# EasyEDA Pro project RN8302B-c8t6 V3.1.eprj, schematic Schematic1

## Sheets
1 stm32主电路: Create Date: 2024-05-13; Page Name: stm32主电路; Project Name: 电能计量模块BC20; Schematic Name: Schematic1; Update Date: 2024-06-25; Company: ls; Drawed: ls; Page Size: A3; Reviewed: ls; Version: V1.0
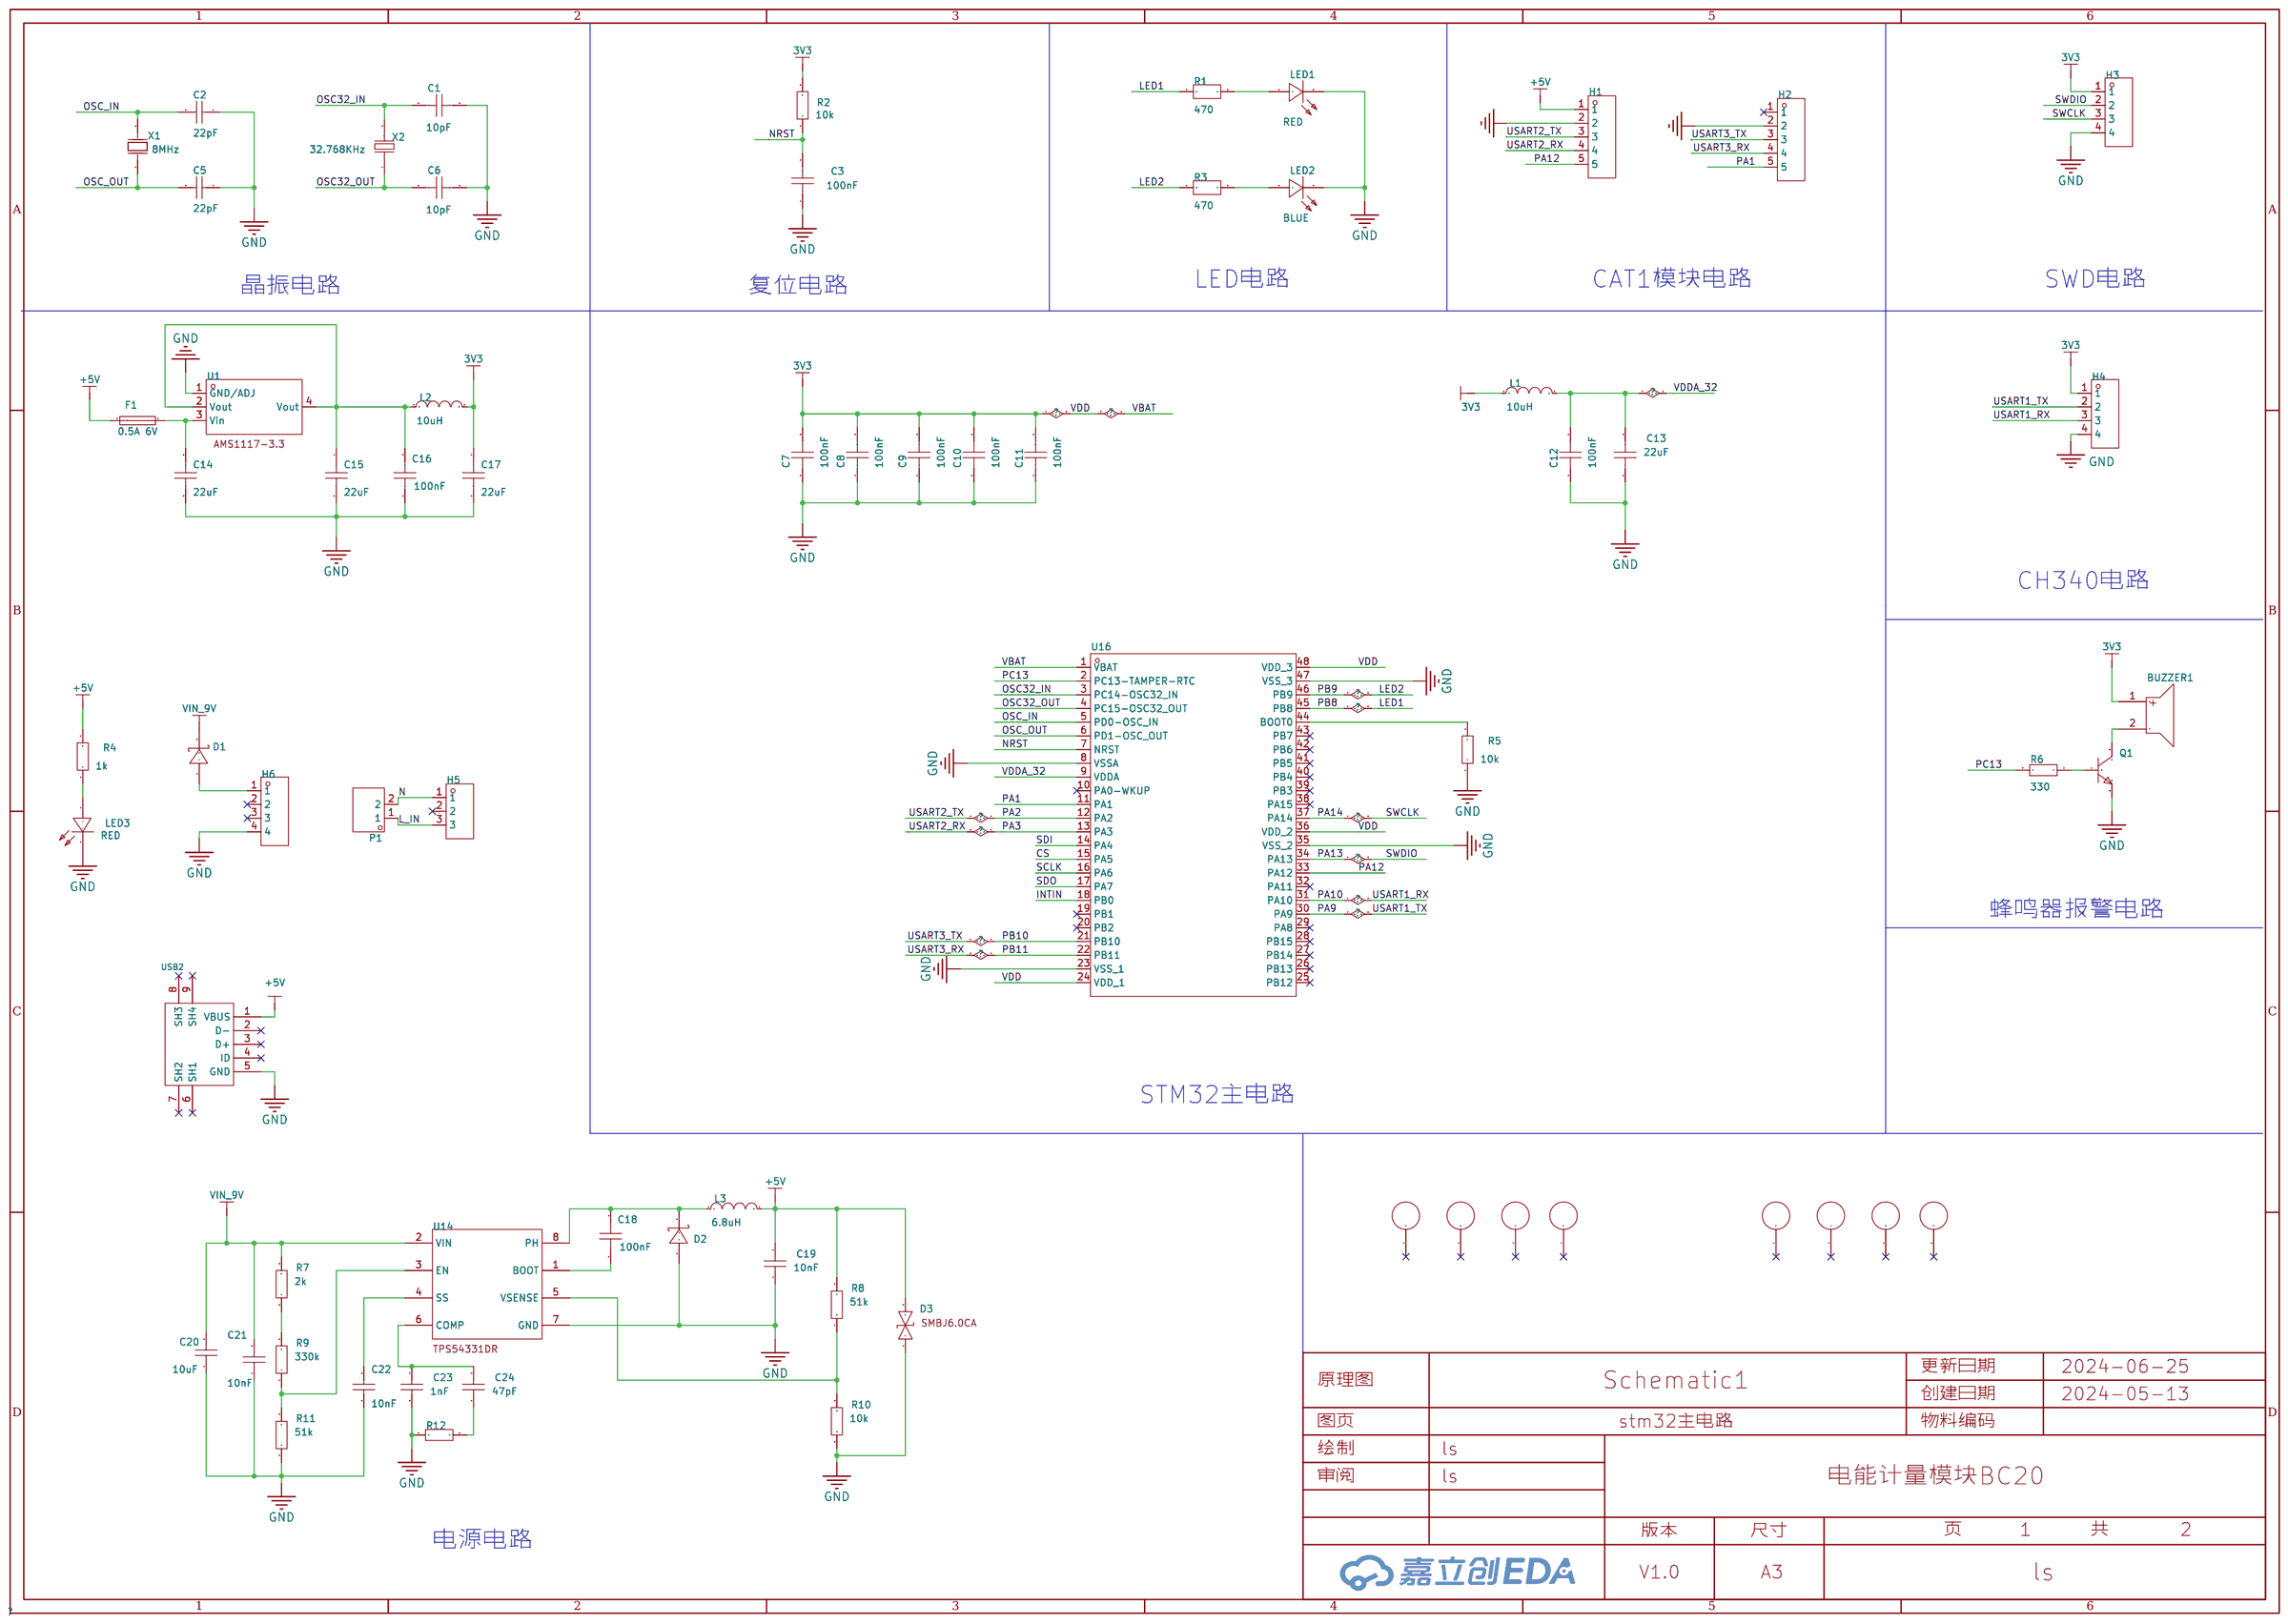
[diagram p0: stm32主电路]
2 RN8302: Board Name: Board1; Page Name: RN8302; Update Date: 2024-06-24
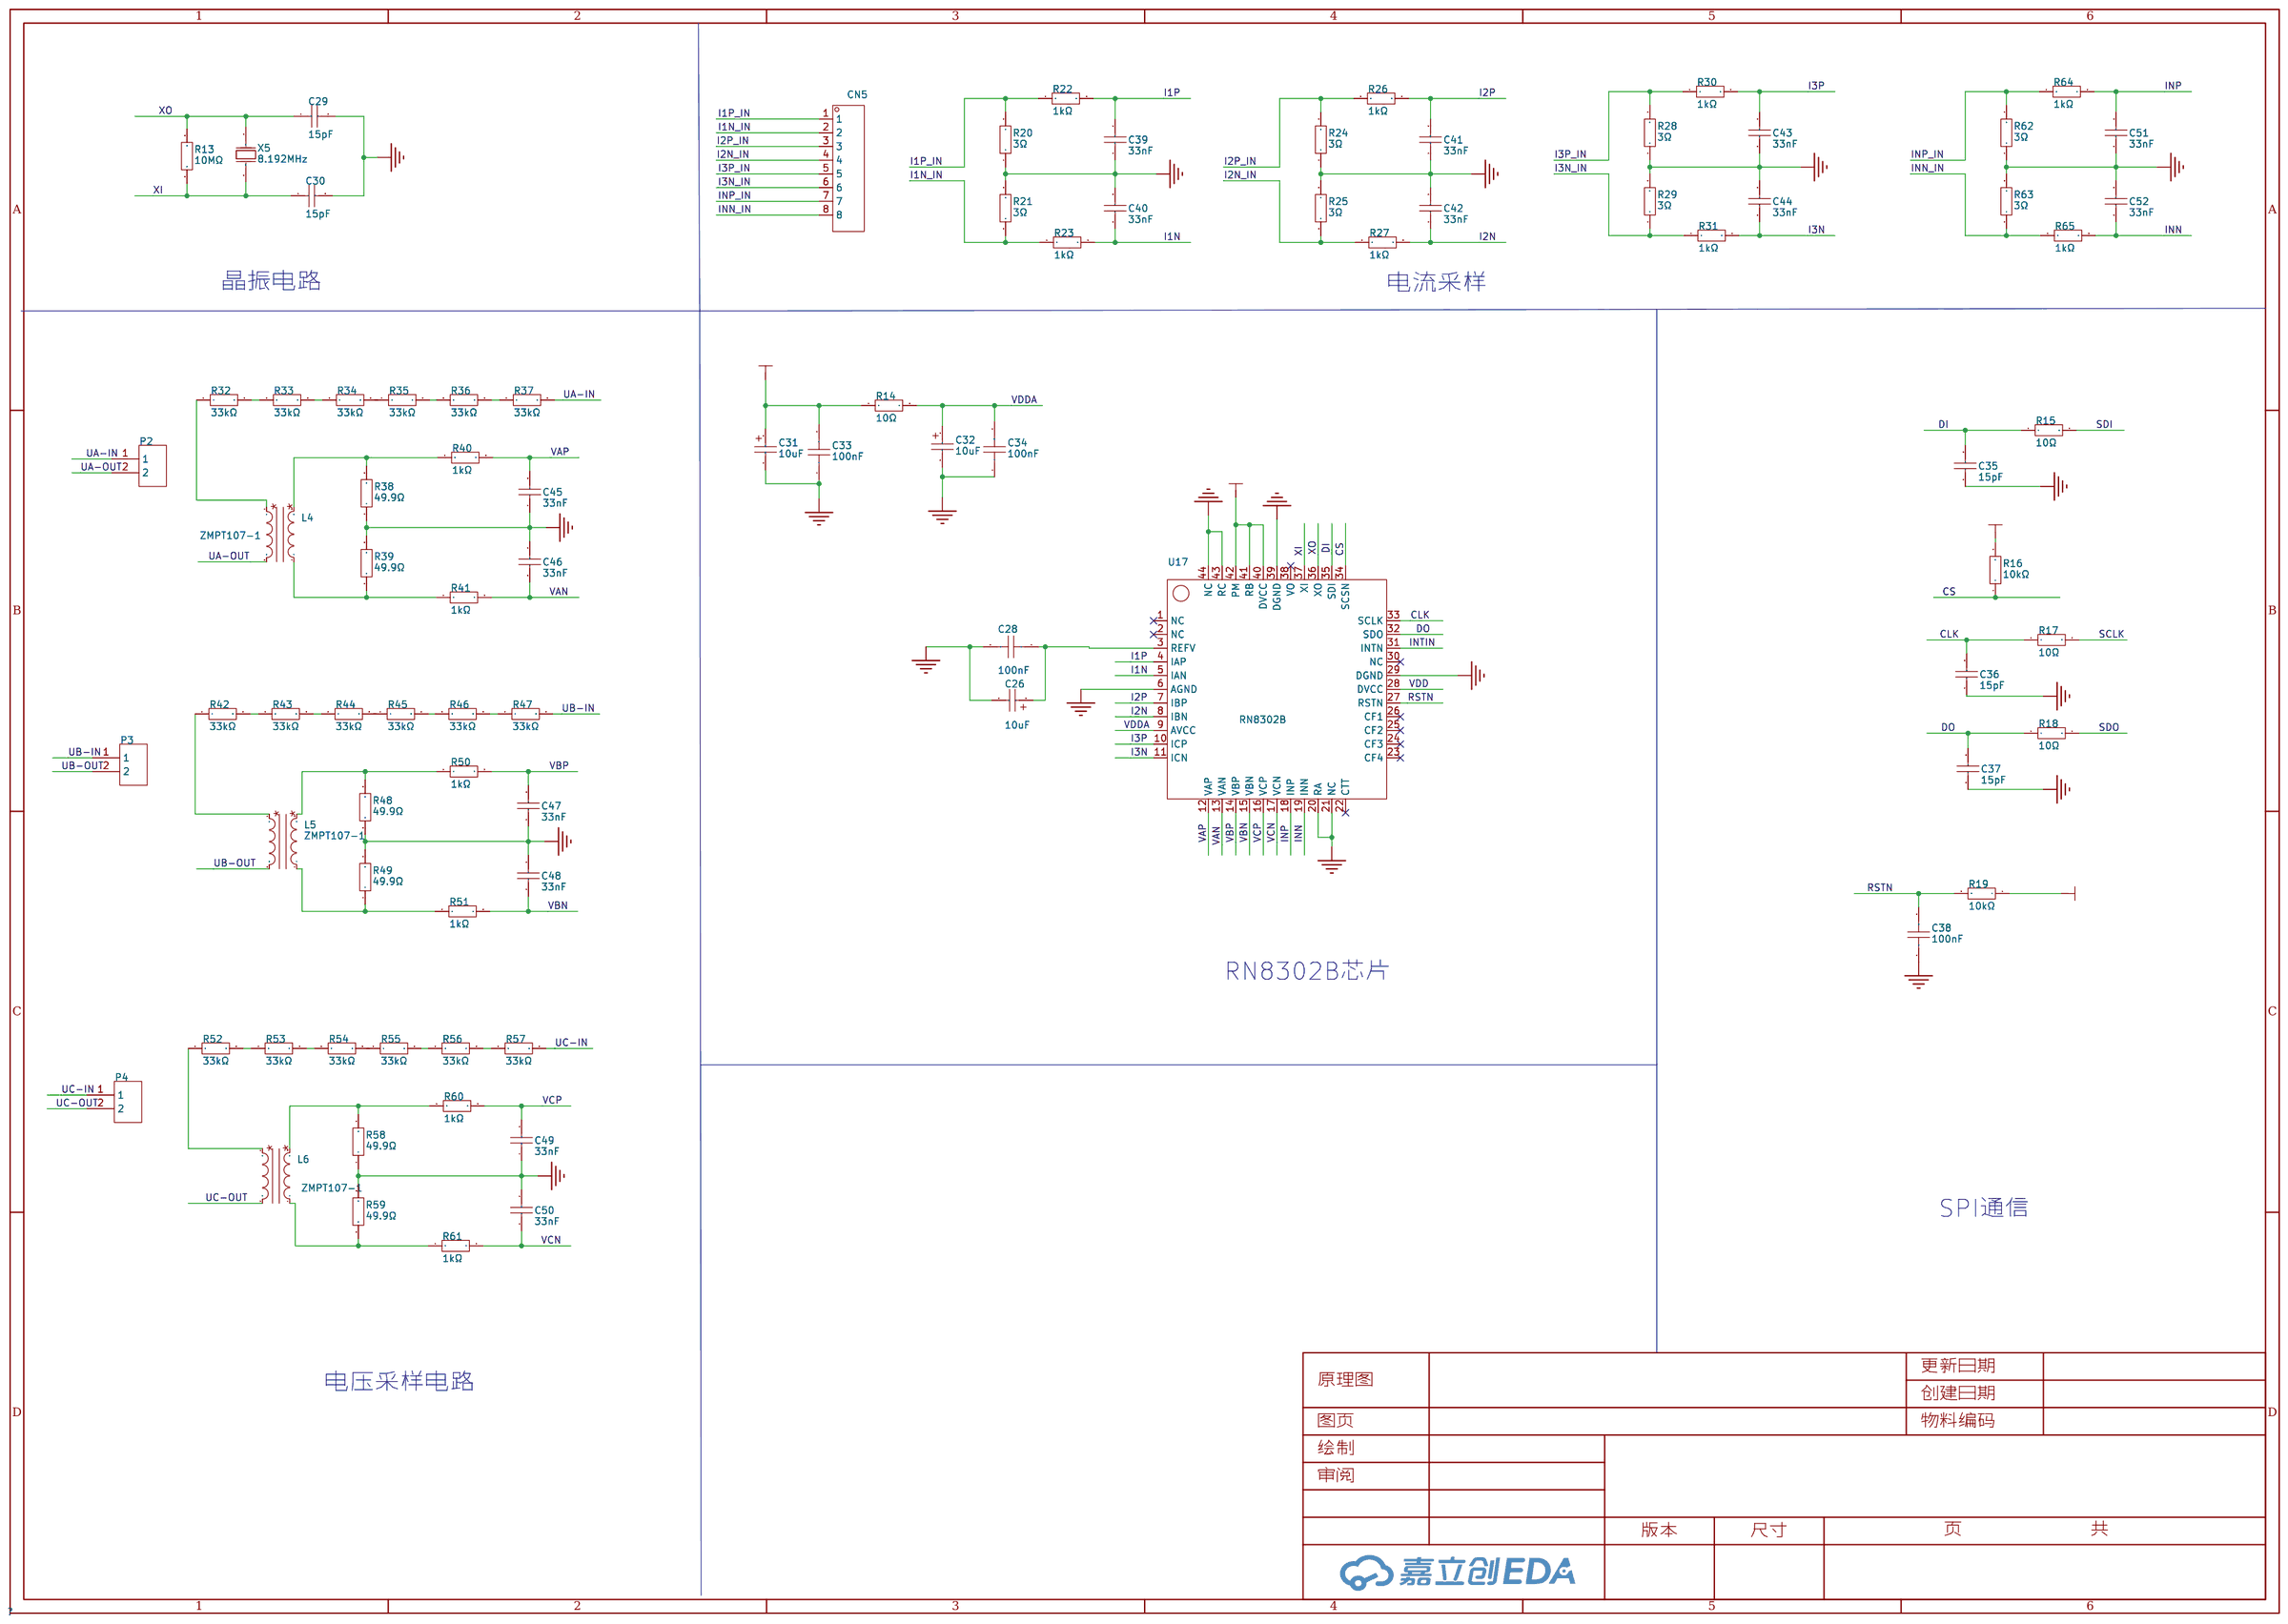
[diagram p1: RN8302]

## Parts
sheet RN8302
C26  10uF  [CAP-SMD_L3.2-W1.6-RD-C7171]
C28  100nF  [C0603]
C29  15pF  [C0603]
C30  15pF  [C0603]
C31  10uF  [CAP-SMD_L3.2-W1.6-RD-C7171]
C32  10uF  [CAP-SMD_L3.2-W1.6-RD-C7171]
C33  100nF  [C0603]
C34  100nF  [C0603]
C35  15pF  [C0603]
C36  15pF  [C0603]
C37  15pF  [C0603]
C38  100nF  [C0603]
C39  33nF  [C0603]
C40  33nF  [C0603]
C41  33nF  [C0603]
C42  33nF  [C0603]
C43  33nF  [C0603]
C44  33nF  [C0603]
C45  33nF  [C0603]
C46  33nF  [C0603]
C47  33nF  [C0603]
C48  33nF  [C0603]
C49  33nF  [C0603]
C50  33nF  [C0603]
C51  33nF  [C0603]
C52  33nF  [C0603]
CN5  WJ15EDGRC-3.81-8P  [CONN-TH_8P-P3.81_WJ15EDGRC-3.81-8P]
L4  ZMPT107-1  [XFMR-TH_ZMPT107-1]
L5  ZMPT107-1  [XFMR-TH_ZMPT107-1]
L6  ZMPT107-1  [XFMR-TH_ZMPT107-1]
P2  WJ500V-5.08-2P  [CONN-TH_2P-P5.00_WJ500V-5.08-2P]
P3  WJ500V-5.08-2P  [CONN-TH_2P-P5.00_WJ500V-5.08-2P]
P4  WJ500V-5.08-2P  [CONN-TH_2P-P5.00_WJ500V-5.08-2P]
R13  10MΩ  [R0603]
R14  10Ω  [R0603]
R15  10Ω  [R0603]
R16  10kΩ  [R0603]
R17  10Ω  [R0603]
R18  10Ω  [R0603]
R19  10kΩ  [R0603]
R20  3Ω  [R0603]
R21  3Ω  [R0603]
R22  1kΩ  [R0603]
R23  1kΩ  [R0603]
R24  3Ω  [R0603]
R25  3Ω  [R0603]
R26  1kΩ  [R0603]
R27  1kΩ  [R0603]
R28  3Ω  [R0603]
R29  3Ω  [R0603]
R30  1kΩ  [R0603]
R31  1kΩ  [R0603]
R32  33kΩ  [R0603]
R33  33kΩ  [R0603]
R34  33kΩ  [R0603]
R35  33kΩ  [R0603]
R36  33kΩ  [R0603]
R37  33kΩ  [R0603]
R38  49.9Ω  [R0603]
R39  49.9Ω  [R0603]
R40  1kΩ  [R0603]
R41  1kΩ  [R0603]
R42  33kΩ  [R0603]
R43  33kΩ  [R0603]
R44  33kΩ  [R0603]
R45  33kΩ  [R0603]
R46  33kΩ  [R0603]
R47  33kΩ  [R0603]
R48  49.9Ω  [R0603]
R49  49.9Ω  [R0603]
R50  1kΩ  [R0603]
R51  1kΩ  [R0603]
R52  33kΩ  [R0603]
R53  33kΩ  [R0603]
R54  33kΩ  [R0603]
R55  33kΩ  [R0603]
R56  33kΩ  [R0603]
R57  33kΩ  [R0603]
R58  49.9Ω  [R0603]
R59  49.9Ω  [R0603]
R60  1kΩ  [R0603]
R61  1kΩ  [R0603]
R62  3Ω  [R0603]
R63  3Ω  [R0603]
R64  1kΩ  [R0603]
R65  1kΩ  [R0603]
U17  RN8302B  [LQFP-44_L10.0-W10.0-P0.80-LS12.0-BL]
X5  8.192MHz  [HC-49US_L11.5-W4.5-P4.88]
sheet stm32主电路
BUZZER1  KXG0903C3  [buz-th_bd9.6-p5.00-d0.7-fd]
C1  10pF  [c0805]
C2  22pF  [c0805]
C3  100nF  [c0805]
C5  22pF  [c0805]
C6  10pF  [c0805]
C7  100nF  [c0805]
C8  100nF  [c0805]
C9  100nF  [c0805]
C10  100nF  [c0805]
C11  100nF  [c0805]
C12  100nF  [c0805]
C13  22uF  [c0805]
C14  22uF  [c0805]
C15  22uF  [c0805]
C16  100nF  [c0805]
C17  22uF  [c0805]
C18  100nF  [c0805]
C19  10nF  [c0603]
C20  10uF  [c1206]
C21  10nF  [c0603]
C22  10nF  [c0603]
C23  1nF  [c0402]
C24  47pF  [c0402]
D1  -  [sma_l4.3-w2.6-ls5.2-rd]
D2  -  [smb_l4.6-w3.6-ls5.3-rd]
D3  -  [smb_l4.6-w3.6-ls5.3-bi]
F1  0.5A 6V  [f0805]
H1  PM254-1-05-Z-8.5  [HDR-TH_5P-P2.54-V-F]
H2  PM254-1-05-Z-8.5  [HDR-TH_5P-P2.54-V-F]
H3  -  [hdr-th_4p-p2.54-v-m]
H4  -  [hdr-th_4p-p2.54-v-m-1]
H5  Z-211-0311-0021-001  [hdr-th_3p-p2.54-v-m-1_1]
H6  -  [hdr-th_4p-p2.54-v-m-1]
L1  10uH  [l0805]
L2  10uH  [l0805]
L3  6.8uH  [ind-smd_l6.0-w6.0_slf6025]
LED1  RED  [led0805-r-rd]
LED2  BLUE  [led0805-r-rd]
LED3  RED  [led0805-r-rd]
P1  WJ15EDGRC-3.81-2P  [conn-th_2p-p3.81_wj15edgrc-3.81-2p]
Q1  S8050  [sot-23-3_l2.9-w1.3-p1.90-ls2.4-br]
R1  470  [r0805]
R2  10k  [r0805]
R3  470  [r0805]
R4  1k  [r0805]
R5  10k  [r0805]
R6  330  [r0805]
R7  2k  [r0805]
R8  51k  [r0805]
R9  330k  [r0805]
R10  10k  [r0603]
R11  51k  [r0805]
R12  -  [r0603]
U1  -  [sot-223-3_l6.5-w3.4-p2.30-ls7.0-br]
U3  -  [smd_bd4.2-l4.7-w4.7-d3.0]
U4  -  [smd_bd4.2-l4.7-w4.7-d3.0]
U5  -  [smd_bd4.2-l4.7-w4.7-d3.0]
U6  -  [smd_bd4.2-l4.7-w4.7-d3.0]
U7  -  [smd_bd4.2-l4.7-w4.7-d3.0]
U8  -  [smd_bd4.2-l4.7-w4.7-d3.0]
U9  -  [smd_bd4.2-l4.7-w4.7-d3.0]
U10  -  [smd_bd4.2-l4.7-w4.7-d3.0]
U14  -  [soic-8_l5.0-w4.0-p1.27-ls6.0-bl]
U16  STM32F103C8T6  [lqfp-48_l7.0-w7.0-p0.50-ls9.0-bl_4]
USB2  MicroXNJ  [micro-usb-smd_microxnj_1]
X1  8MHz  [osc-th_l11.1-w4.7-p4.88]
X2  32.768KHz  [osc-th_bd3.0-p1.10-d0.4]

## Library data of the parts
C26 C31 C32 = TAJA106K016RNJ: 容值:10uF;精度:±10%;额定电压:16V;等效串联电阻:3Ω@100kHz;; LCSC Part Name: 10uF ±10% 16V; Supplier Part: C7171; Manufacturer: Kyocera AVX; Supplier Footprint: CASE-A-3216; JLCPCB Part Class: 基础库; Datasheet: https://atta.szlcsc.com/upload/public/pdf/source/20160107/1457707750344.pdf; Supplier: LCSC; Tolerance: ±10%; Rated Voltage: 16V; Equivalent Series Resistance(ESR): 3Ω@100kHz; Operating Temperature: -55℃~+125℃
C28 C33 C34 C38 = CC0603KRX7R9BB104: 容值:100nF;精度:±10%;额定电压:50V;材质(温度系数):X7R;; LCSC Part Name: 100nF ±10% 50V; Supplier Part: C14663; Manufacturer: YAGEO(国巨); Supplier Footprint: 0603; JLCPCB Part Class: 基础库; Datasheet: https://atta.szlcsc.com/upload/public/pdf/source/20180910/C282072_33301C7F631E79921B82A8DAC6BCC5B3.pdf; Supplier: LCSC; Tolerance: ±10%; Voltage Rated: 50V; Temperature Coefficient: X7R
C29 C30 C35-C37 = CC0603JRNPO9BN150: 容值:15pF;精度:±5%;额定电压:50V;材质(温度系数):NP0;; LCSC Part Name: 15pF ±5% 50V; Supplier Part: C107037; Manufacturer: YAGEO(国巨); Supplier Footprint: 0603; JLCPCB Part Class: 扩展库; Datasheet: https://atta.szlcsc.com/upload/public/pdf/source/20170914/C128857_1505359892143968080.pdf; Supplier: LCSC; Tolerance: ±5%; Voltage Rated: 50V; Temperature Coefficient: NP0
C39-C52 = CL10B333KB8NNNC: 容值:33nF;精度:±10%;额定电压:50V;材质(温度系数):X7R;; LCSC Part Name: 33nF ±10% 50V; Supplier Part: C21117; Manufacturer: SAMSUNG(三星); Supplier Footprint: 0603; JLCPCB Part Class: 基础库; Datasheet: https://atta.szlcsc.com/upload/public/pdf/source/20160218/1457707763339.pdf; Supplier: LCSC; Tolerance: ±10%; Voltage Rated: 50V; Temperature Coefficient: X7R
CN5 = WJ15EDGRC-3.81-8P: LCSC Part Name: 1x8P 3.81mm 排数:1 每排P数:8; Supplier Part: C14235; Manufacturer: KANGNEX(康奈克斯电气); Supplier Footprint: 弯插,P=3.81mm; JLCPCB Part Class: 扩展库; Datasheet: https://atta.szlcsc.com/upload/public/pdf/source/20191225/C14235_C8BDA83BBDBD01ECF9C88040C6983038.pdf; Supplier: LCSC; Connector Type: 板端/插座-闭口; Structure: 1x8P; Pitch: 3.81mm; Mounting Style: 弯针; Number of Pins: 8P; Number of Rows: 1; Number of PINs Per Row: 8; Current Rating (Max): 8A; Voltage Rating (Max): 300V; Contact Material: 黄铜; Contact Plating: 锡; Operating Temperature Range: -40℃~+105℃
L4-L6 = ZMPT107-1_C125191: 类型:电压互感器;匝数比:1:1;额定输入电流:2mA;额定输出电流:2mA;频率范围:-;次级侧电感值:-;; Supplier Part: C125191; Manufacturer: 择明朗熙; Supplier Footprint: 插件; JLCPCB Part Class: 扩展库; Datasheet: https://atta.szlcsc.com/upload/public/pdf/source/20200113/C482589_3E4F38C8012CAB1F8FE7F318F1CE8B25.pdf; Supplier: LCSC; Type: 电压互感器; Current Ratio: 1:1; Current Rating: 2mA; Rated Output Current: 2mA; Linearity: 0.2%
P2-P4 = WJ500V-5.08-2P: 结构:1x2P;间距:5.08mm;颜色:绿色;安装方式:直插;额定电流:18A;额定电压:250V;排数:1;线规 - AWG:14~30;线规 - 平方毫米:2.5;每排PIN数:2;触头材质:-;触头镀层:-;工作温度范围:-40℃~+105℃;焊接温度(最大值):-;; LCSC Part Name: 1x2P 5.08mm 直插 排数:1 每排P数:2; Supplier Part: C8465; Manufacturer: KANGNEX(康奈克斯电气); Supplier Footprint: 插件,P=5.08mm; JLCPCB Part Class: 扩展库; Datasheet: https://atta.szlcsc.com/upload/public/pdf/source/20191225/C8465_02D34CE5B5B4A53DF5891601D97FA9F4.pdf; Supplier: LCSC; Structure: 1x2P; Pitch: 5.08mm; Color: 绿色; Mounting Style: 直插; Current Rating (Max): 18A; Voltage Rating (Max): 250V; Number of Pins: 2P; Number of Rows: 1; Wire Gauge - AWG: 14~30; Wire Gauge - mm2: 2.5; Number of PINs Per Row: 2; Operating Temperature Range: -40℃~+105℃; Screw Specification: M2.5
R13 = 0603WAF1005T5E: 电阻类型:厚膜电阻;阻值:10MΩ;精度:±1%;功率:100mW;最大工作电压:75V;温度系数:±100ppm/℃;; LCSC Part Name: 10MΩ ±1% 100mW 厚膜电阻; Supplier Part: C7250; Manufacturer: UNI-ROYAL(厚声); Supplier Footprint: 0603; JLCPCB Part Class: 基础库; Datasheet: https://atta.szlcsc.com/upload/public/pdf/source/20200306/C422600_1E6D84923E4A46A82E41ADD87F860B5C.pdf; Supplier: LCSC; Type: 厚膜电阻; Tolerance: ±1%; Power(Watts): 100mW; Overload Voltage (Max): 75V; Temperature Coefficient: ±100ppm/℃; Operating Temperature Range: -55℃~+155℃
R14 R15 R17 R18 = 0603WAF100JT5E: 电阻类型:厚膜电阻;阻值:10Ω;精度:±1%;功率:100mW;最大工作电压:75V;温度系数:±400ppm/℃;; LCSC Part Name: 10Ω ±1% 100mW 厚膜电阻; Supplier Part: C22859; Manufacturer: UNI-ROYAL(厚声); Supplier Footprint: 0603; JLCPCB Part Class: 基础库; Datasheet: https://atta.szlcsc.com/upload/public/pdf/source/20200306/C422600_1E6D84923E4A46A82E41ADD87F860B5C.pdf; Supplier: LCSC; Type: 厚膜电阻; Tolerance: ±1%; Power(Watts): 100mW; Overload Voltage (Max): 75V; Temperature Coefficient: ±400ppm/℃; Operating Temperature Range: -55℃~+155℃
R16 R19 = 0603WAF1002T5E: 电阻类型:厚膜电阻;阻值:10kΩ;精度:±1%;功率:100mW;最大工作电压:75V;温度系数:±100ppm/℃;; LCSC Part Name: 厚膜电阻 10kΩ ±1% 100mW; Supplier Part: C25804; Manufacturer: UNI-ROYAL(厚声); Supplier Footprint: 0603; JLCPCB Part Class: 基础库; Datasheet: https://atta.szlcsc.com/upload/public/pdf/source/20200306/C422600_1E6D84923E4A46A82E41ADD87F860B5C.pdf; Supplier: LCSC; Type: 厚膜电阻; Tolerance: ±1%; Power(Watts): 100mW; Overload Voltage (Max): 75V; Temperature Coefficient: ±100ppm/℃; Operating Temperature Range: -55℃~+155℃
R20 R21 R24 R25 R28 R29 R62 R63 = 0603WAF300KT5E: 电阻类型:厚膜电阻;阻值:3Ω;精度:±1%;功率:100mW;最大工作电压:75V;温度系数:±200ppm/℃;; LCSC Part Name: 3Ω ±1% 100mW 厚膜电阻; Supplier Part: C23157; Manufacturer: UNI-ROYAL(厚声); Supplier Footprint: 0603; JLCPCB Part Class: 扩展库; Datasheet: https://atta.szlcsc.com/upload/public/pdf/source/20200306/C422600_1E6D84923E4A46A82E41ADD87F860B5C.pdf; Supplier: LCSC; Type: 厚膜电阻; Tolerance: ±1%; Power(Watts): 100mW; Overload Voltage (Max): 75V; Temperature Coefficient: ±200ppm/℃; Operating Temperature Range: -55℃~+155℃
R22 R23 R26 R27 R30 R31 R40 R41 R50 R51 R60 R61 R64 R65 = 0603WAF1001T5E: 电阻类型:厚膜电阻;阻值:1kΩ;精度:±1%;功率:100mW;最大工作电压:75V;温度系数:±100ppm/℃;; LCSC Part Name: 1kΩ ±1% 100mW 厚膜电阻; Supplier Part: C21190; Manufacturer: UNI-ROYAL(厚声); Supplier Footprint: 0603; JLCPCB Part Class: 基础库; Datasheet: https://atta.szlcsc.com/upload/public/pdf/source/20200306/C422600_1E6D84923E4A46A82E41ADD87F860B5C.pdf; Supplier: LCSC; Type: 厚膜电阻; Tolerance: ±1%; Power(Watts): 100mW; Overload Voltage (Max): 75V; Temperature Coefficient: ±100ppm/℃; Operating Temperature Range: -55℃~+155℃